# Altium schematic sheet FPGA_IOs.SchDoc
size A1
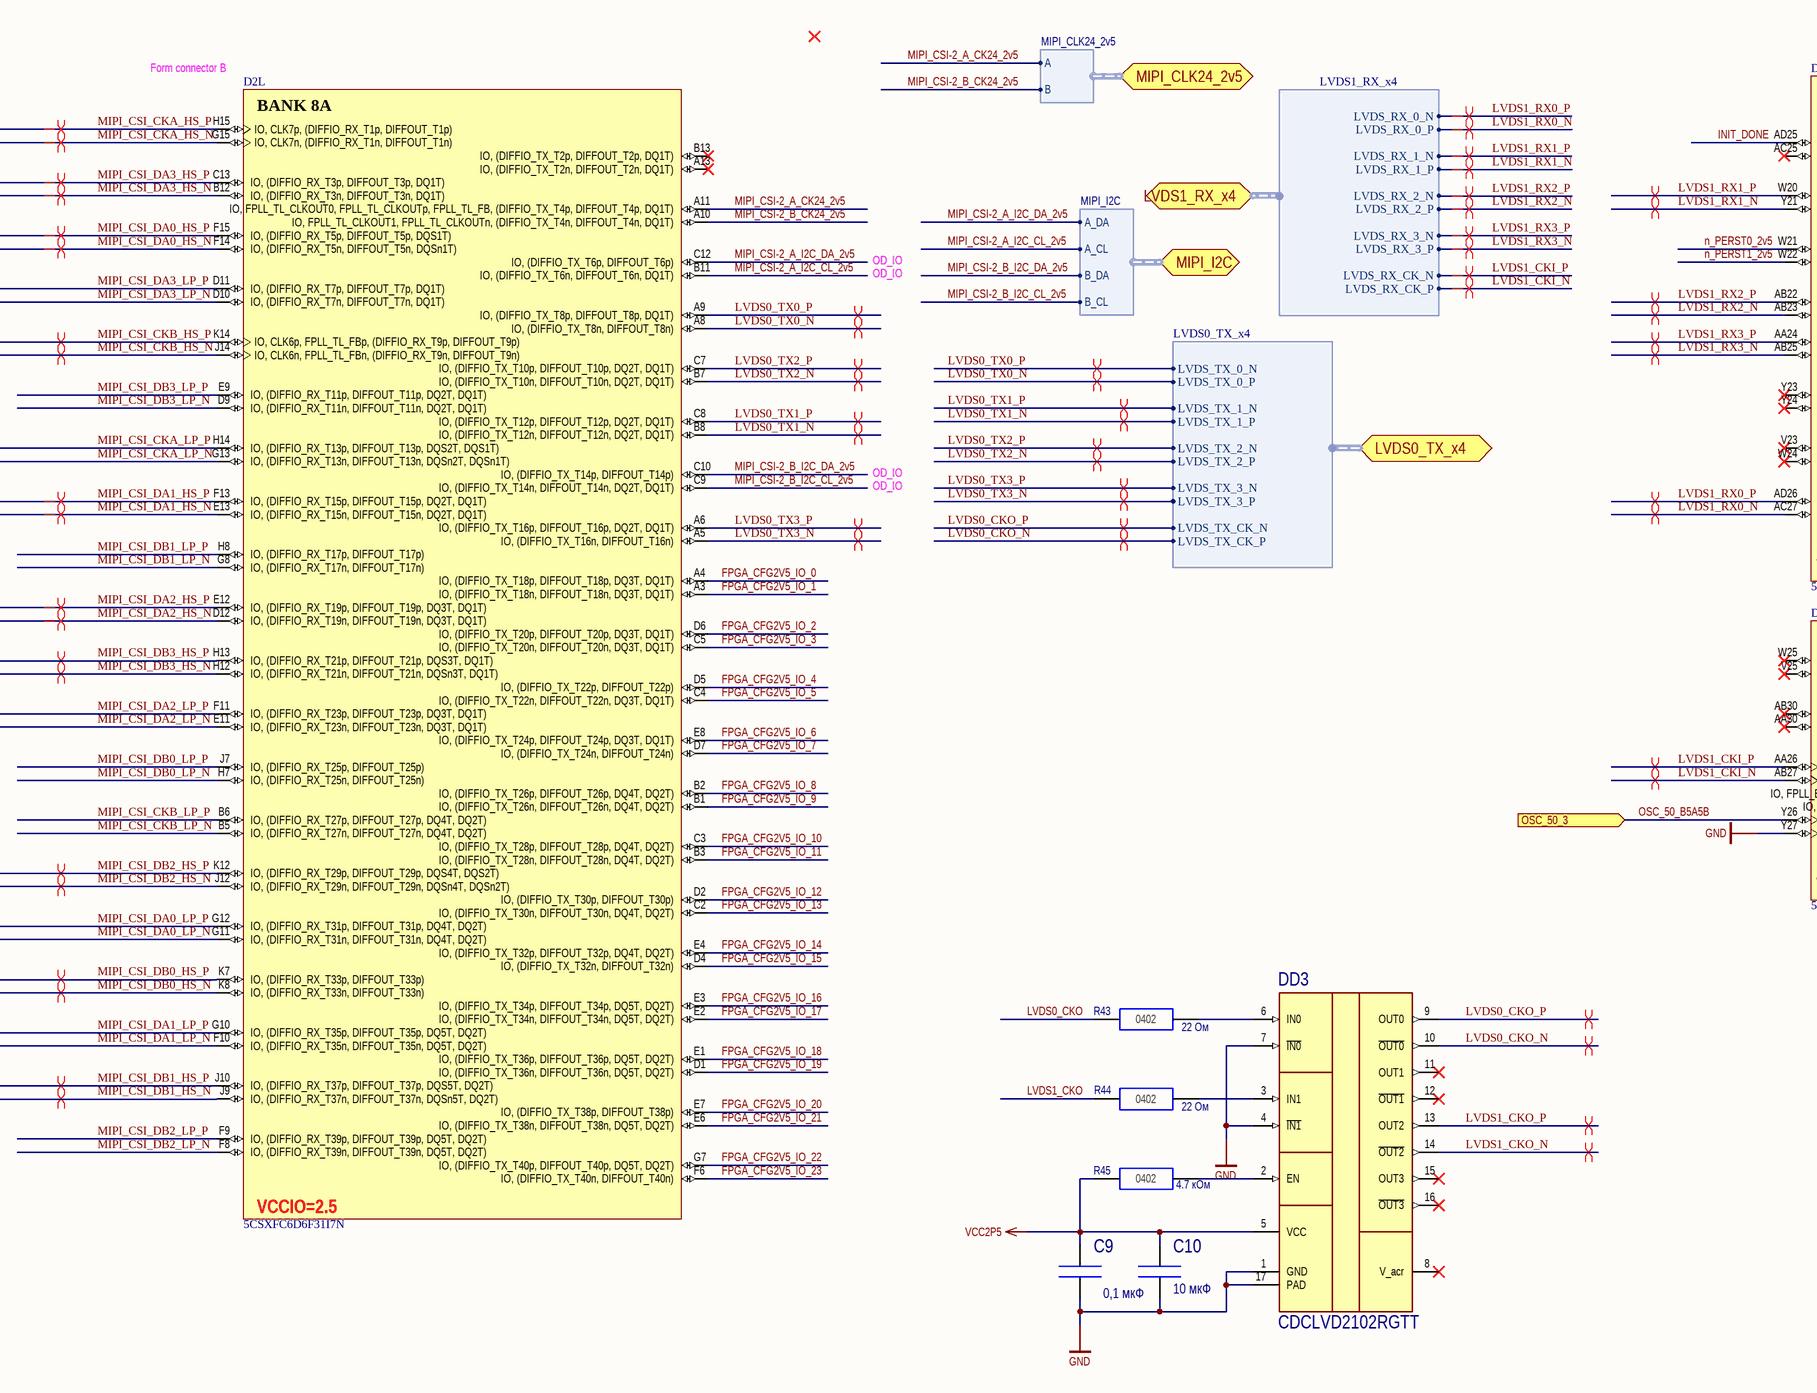
[diagram p0: FPGA_IOs.SchDoc, top left]
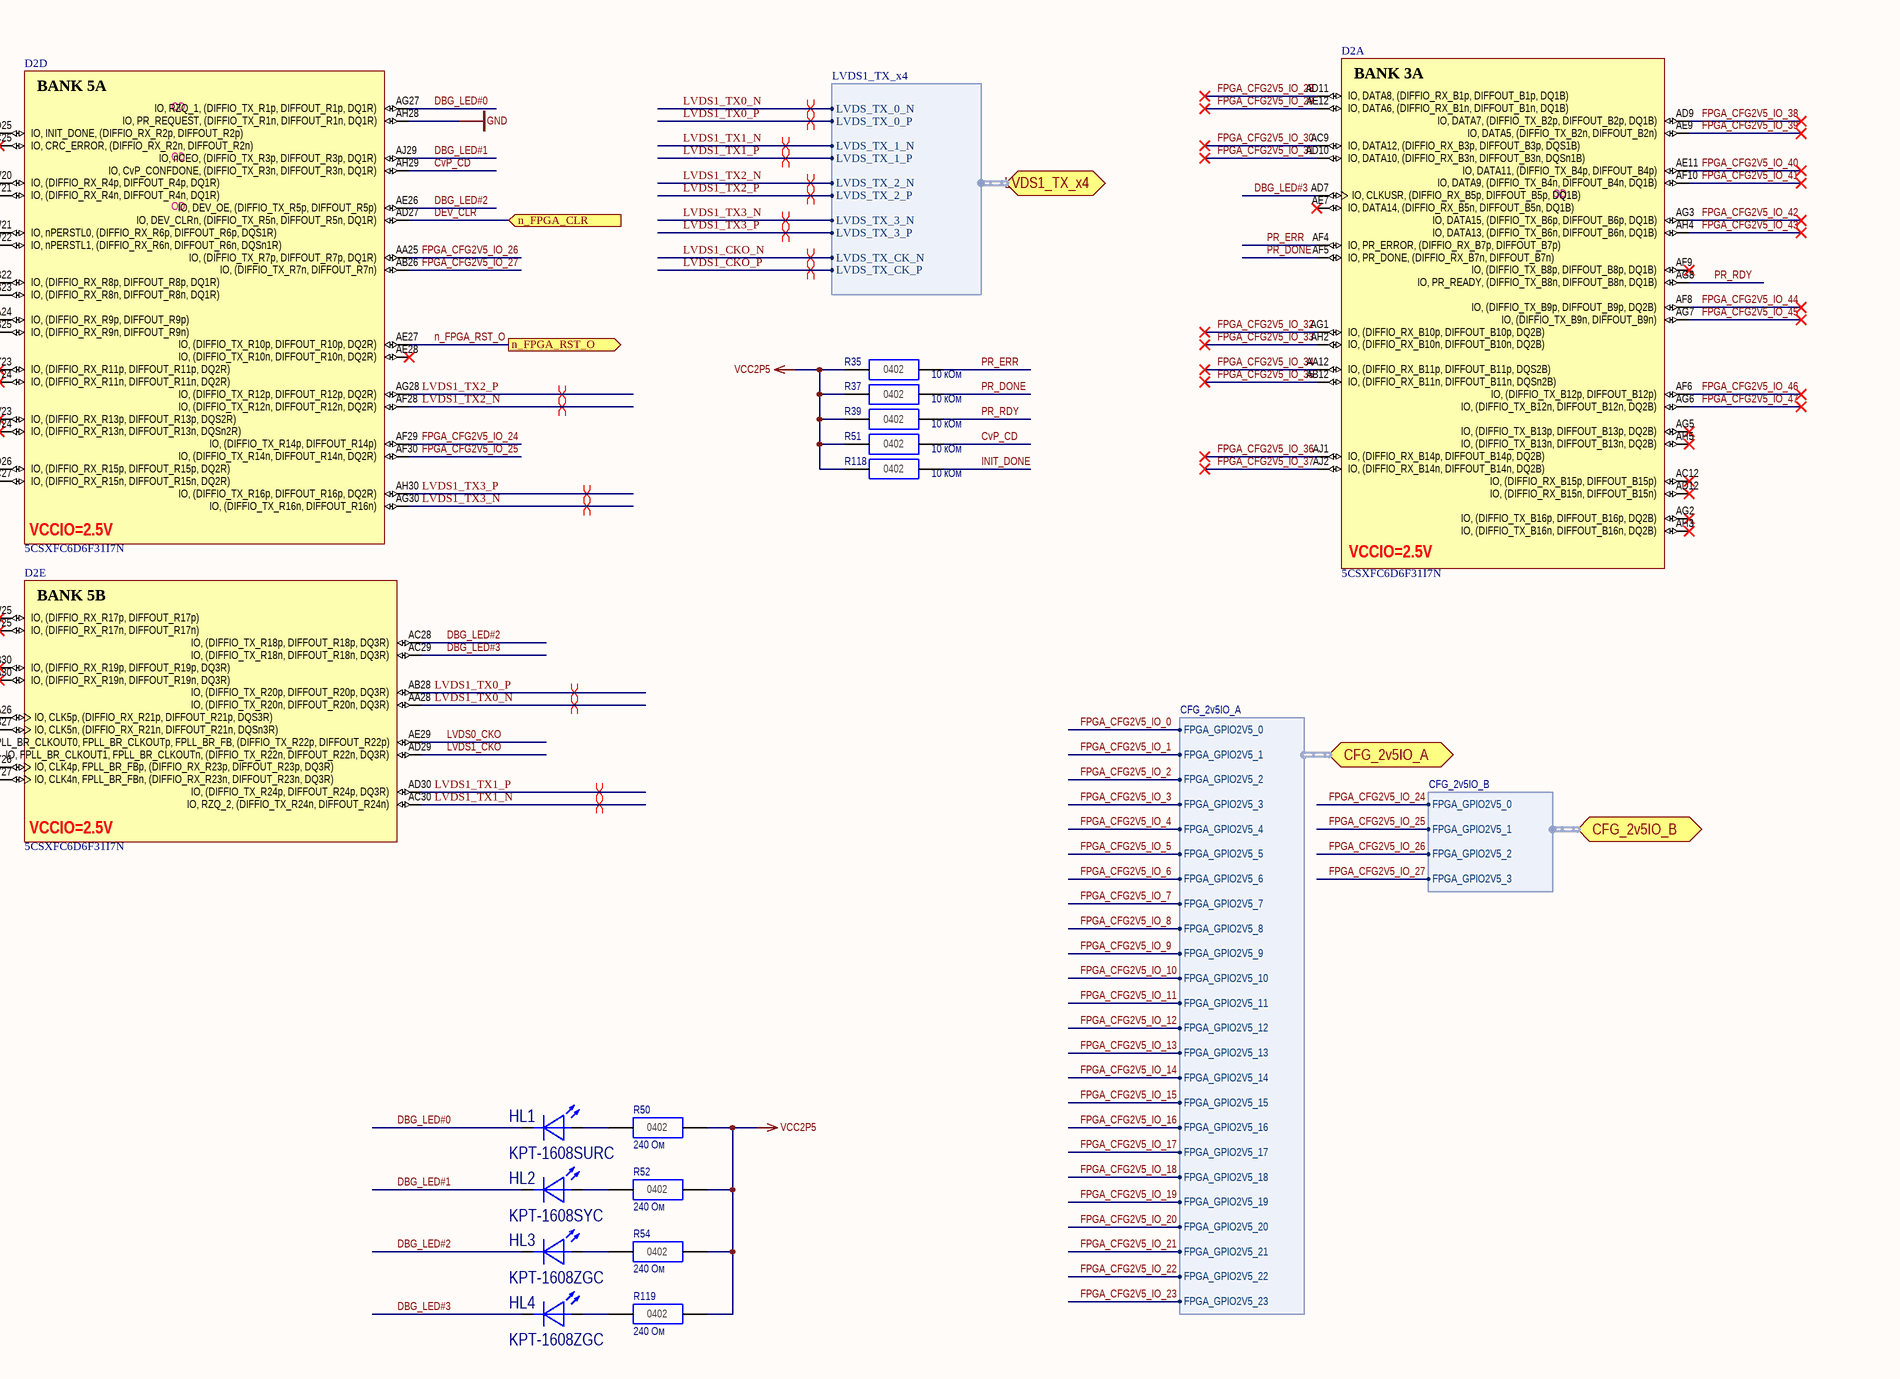
[diagram p1: FPGA_IOs.SchDoc, top right]
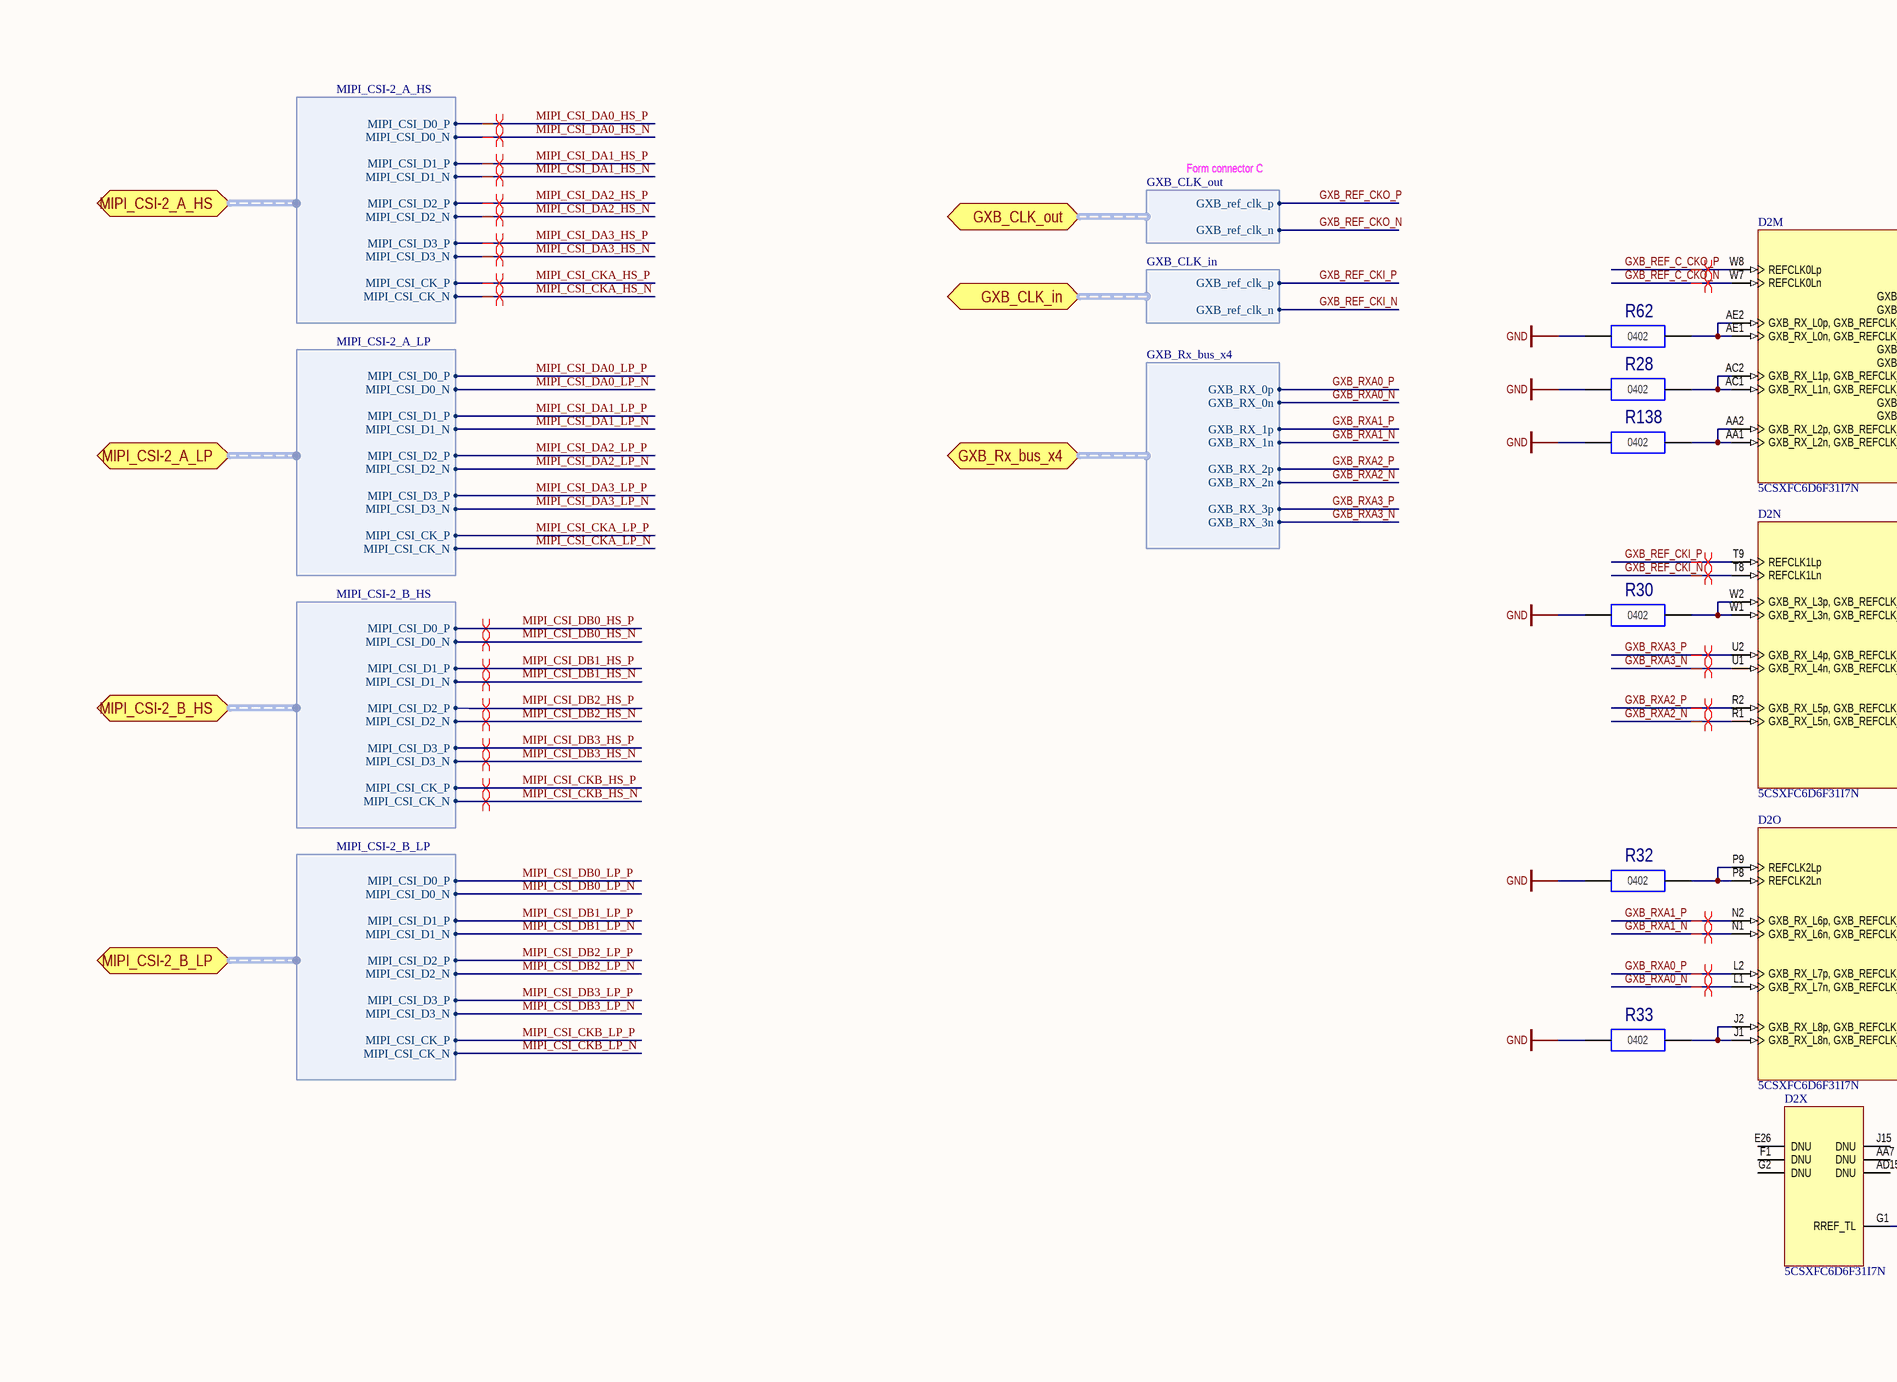
[diagram p2: FPGA_IOs.SchDoc, bottom left]
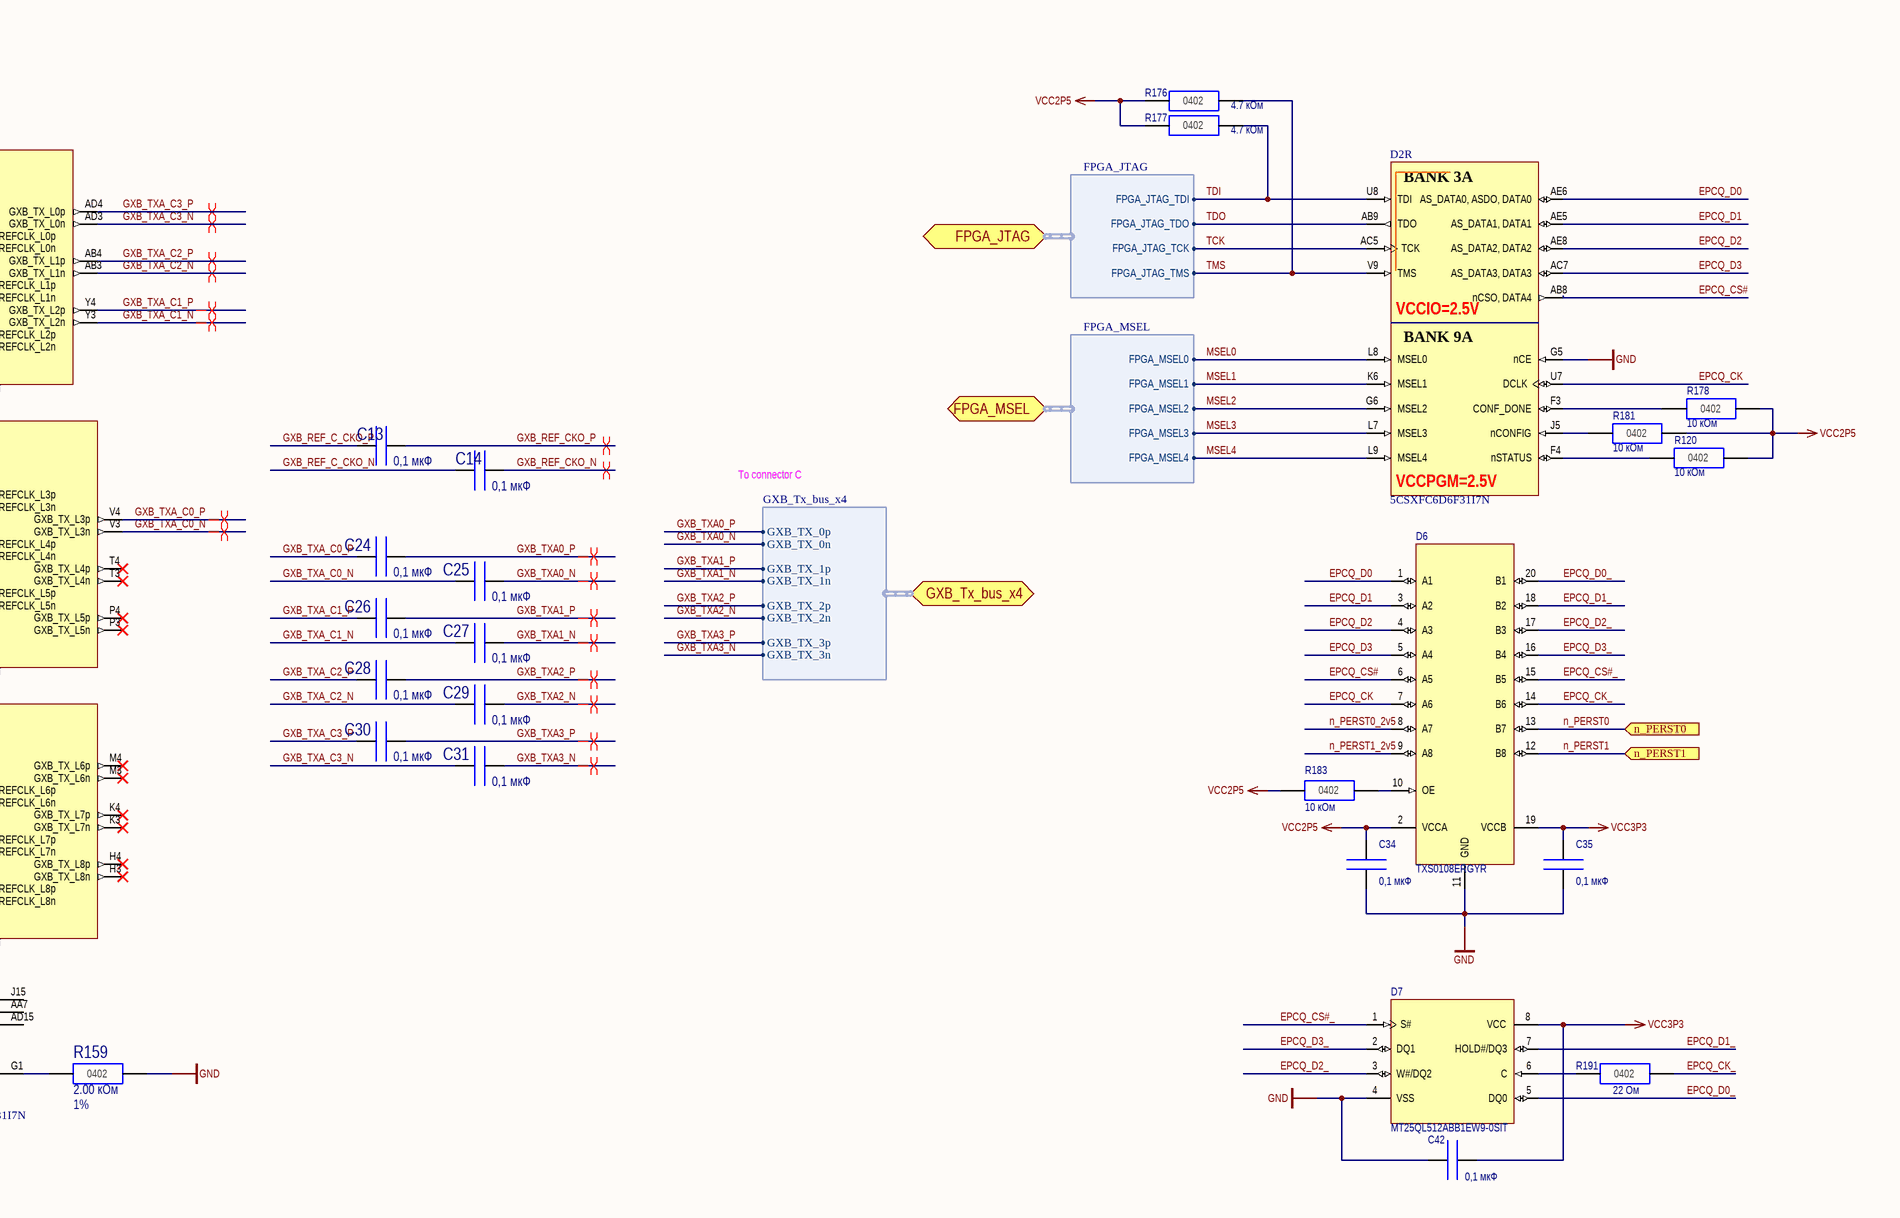
[diagram p3: FPGA_IOs.SchDoc, bottom right]

## Parts
C9  value 0,1 мкФ  [CC0402(1005)]  (hidden comment: CC0402-X7R-0,1 мкФ-20%-10В)
C10  value 10 мкФ  [CC0402(1005)]  (hidden comment: CC0402-X5R-10 мкФ-20%-6.3В)
C13  value 0,1 мкФ  [CC0402(1005)]  (hidden comment: CC0402-X7R-0,1 мкФ-20%-10В)
C14  value 0,1 мкФ  [CC0402(1005)]  (hidden comment: CC0402-X7R-0,1 мкФ-20%-10В)
C24  value 0,1 мкФ  [CC0402(1005)]  (hidden comment: CC0402-X7R-0,1 мкФ-20%-10В)
C25  value 0,1 мкФ  [CC0402(1005)]  (hidden comment: CC0402-X7R-0,1 мкФ-20%-10В)
C26  value 0,1 мкФ  [CC0402(1005)]  (hidden comment: CC0402-X7R-0,1 мкФ-20%-10В)
C27  value 0,1 мкФ  [CC0402(1005)]  (hidden comment: CC0402-X7R-0,1 мкФ-20%-10В)
C28  value 0,1 мкФ  [CC0402(1005)]  (hidden comment: CC0402-X7R-0,1 мкФ-20%-10В)
C29  value 0,1 мкФ  [CC0402(1005)]  (hidden comment: CC0402-X7R-0,1 мкФ-20%-10В)
C30  value 0,1 мкФ  [CC0402(1005)]  (hidden comment: CC0402-X7R-0,1 мкФ-20%-10В)
C31  value 0,1 мкФ  [CC0402(1005)]  (hidden comment: CC0402-X7R-0,1 мкФ-20%-10В)
C34  value 0,1 мкФ  [CC0402(1005)]  (hidden comment: CC0402-X7R-0,1 мкФ-20%-10В)
C35  value 0,1 мкФ  [CC0402(1005)]  (hidden comment: CC0402-X7R-0,1 мкФ-20%-10В)
C42  value 0,1 мкФ  [CC0402(1005)]  (hidden comment: CC0402-X7R-0,1 мкФ-20%-10В)
D2  5CSXFC6D6F31I7N  [ALTR-FBGA896_A-200]  (parts A,D,E,L,M,N,O,R,X of 24)
D6  TXS0108ERGYR  [QFN50P450X350X100_HS-21N]
D7  MT25QL512ABB1EW9-0SIT  [SON127P800X80_HS-9N]
DD3  CDCLVD2102RGTT  [QFN50P300X300X100_HS-17N]
HL1  KPT-1608SURC  [LED0603_Red]
HL2  KPT-1608SYC  [LED0603_Yellow]
HL3  KPT-1608ZGC  [LED0603_GREEN]
HL4  KPT-1608ZGC  [LED0603_GREEN]
R28  CR0402-0 Ом-±5%  [CR0402(1005)]  (value not drawn)
R30  CR0402-0 Ом-±5%  [CR0402(1005)]  (value not drawn)
R32  CR0402-0 Ом-±5%  [CR0402(1005)_OCT]  (value not drawn)
R33  CR0402-0 Ом-±5%  [CR0402(1005)]  (value not drawn)
R35  value 10 кОм  [CR0402(1005)_OCT]  (hidden comment: CR0402-10 кОм-±5%)
R37  value 10 кОм  [CR0402(1005)_OCT]  (hidden comment: CR0402-10 кОм-±5%)
R39  value 10 кОм  [CR0402(1005)_OCT]  (hidden comment: CR0402-10 кОм-±5%)
R43  value 22 Ом  [CR0402(1005)]  (hidden comment: CR0402-22 Ом-±5%)
R44  value 22 Ом  [CR0402(1005)]  (hidden comment: CR0402-22 Ом-±5%)
R45  value 4.7 кОм  [CR0402(1005)]  (hidden comment: CR0402-4.7 кОм-±5%)
R50  value 240 Ом  [CR0402(1005)]  (hidden comment: CR0402-240 Ом-±5%)
R51  value 10 кОм  [CR0402(1005)_OCT]  (hidden comment: CR0402-10 кОм-±5%)
R52  value 240 Ом  [CR0402(1005)]  (hidden comment: CR0402-240 Ом-±5%)
R54  value 240 Ом  [CR0402(1005)]  (hidden comment: CR0402-240 Ом-±5%)
R62  CR0402-0 Ом-±5%  [CR0402(1005)]  (value not drawn)
R118  value 10 кОм  [CR0402(1005)_OCT]  (hidden comment: CR0402-10 кОм-±5%)
R119  value 240 Ом  [CR0402(1005)]  (hidden comment: CR0402-240 Ом-±5%)
R120  value 10 кОм  [CR0402(1005)_OCT]  (hidden comment: CR0402-10 кОм-±5%)
R138  CR0402-0 Ом-±5%  [CR0402(1005)]  (value not drawn)
R159  value 2.00 кОм  TOLERANCE: 1%  [CR0402(1005)]  (hidden comment: CR0402-2.00 кОм-±1%)
R176  value 4.7 кОм  [CR0402(1005)_OCT]  (hidden comment: CR0402-4.7 кОм-±5%)
R177  value 4.7 кОм  [CR0402(1005)_OCT]  (hidden comment: CR0402-4.7 кОм-±5%)
R178  value 10 кОм  [CR0402(1005)_OCT]  (hidden comment: CR0402-10 кОм-±5%)
R181  value 10 кОм  [CR0402(1005)_OCT]  (hidden comment: CR0402-10 кОм-±5%)
R183  value 10 кОм  [CR0402(1005)]  (hidden comment: CR0402-10 кОм-±5%)
R191  value 22 Ом  [CR0402(1005)]  (hidden comment: CR0402-22 Ом-±5%)

## Ports
CFG_2v5IO_A (harness CFG_2v5IO_A), CFG_2v5IO_B (harness CFG_2v5IO_B), FPGA_JTAG (harness FPGA_JTAG), FPGA_MSEL (harness FPGA_MSEL), GXB_CLK_in (harness GXB_CLK_in), GXB_CLK_out (harness GXB_CLK_out), GXB_Rx_bus_x4 (harness GXB_Rx_bus_x4), GXB_Tx_bus_x4 (harness GXB_Tx_bus_x4), LVDS0_TX_x4 (harness LVDS0_TX_x4), LVDS1_RX_x4 (harness LVDS1_RX_x4), LVDS1_TX_x4 (harness LVDS1_TX_x4), MIPI_CLK24_2v5 (harness MIPI_CLK24_2v5), MIPI_CSI-2_A_HS (harness MIPI_CSI-2_A_HS), MIPI_CSI-2_A_LP (harness MIPI_CSI-2_A_LP), MIPI_CSI-2_B_HS (harness MIPI_CSI-2_B_HS), MIPI_CSI-2_B_LP (harness MIPI_CSI-2_B_LP), MIPI_I2C (harness MIPI_I2C), n_FPGA_CLR (in), n_FPGA_RST_O (out), n_PERST0 (in), n_PERST1 (in), OSC_50_3 (in)

## Harnesses
GXB_Rx_bus_x4: GXB_RX_0p, GXB_RX_0n, GXB_RX_1p, GXB_RX_1n, GXB_RX_2p, GXB_RX_2n, GXB_RX_3p, GXB_RX_3n
GXB_Tx_bus_x4: GXB_TX_0p, GXB_TX_0n, GXB_TX_1p, GXB_TX_1n, GXB_TX_2p, GXB_TX_2n, GXB_TX_3p, GXB_TX_3n
GXB_CLK_out: GXB_ref_clk_p, GXB_ref_clk_n
GXB_CLK_in: GXB_ref_clk_p, GXB_ref_clk_n
FPGA_JTAG: FPGA_JTAG_TDI, FPGA_JTAG_TDO, FPGA_JTAG_TCK, FPGA_JTAG_TMS
FPGA_MSEL: FPGA_MSEL0, FPGA_MSEL1, FPGA_MSEL2, FPGA_MSEL3, FPGA_MSEL4
CFG_2v5IO_A: FPGA_GPIO2V5_0, FPGA_GPIO2V5_1, FPGA_GPIO2V5_2, FPGA_GPIO2V5_3, FPGA_GPIO2V5_4, FPGA_GPIO2V5_5, FPGA_GPIO2V5_6, FPGA_GPIO2V5_7, FPGA_GPIO2V5_8, FPGA_GPIO2V5_9, FPGA_GPIO2V5_10, FPGA_GPIO2V5_11, FPGA_GPIO2V5_12, FPGA_GPIO2V5_13, FPGA_GPIO2V5_14, FPGA_GPIO2V5_15, FPGA_GPIO2V5_16, FPGA_GPIO2V5_17, FPGA_GPIO2V5_18, FPGA_GPIO2V5_19, FPGA_GPIO2V5_20, FPGA_GPIO2V5_21, FPGA_GPIO2V5_22, FPGA_GPIO2V5_23
MIPI_CSI-2_A_HS: MIPI_CSI_D0_N, MIPI_CSI_D0_P, MIPI_CSI_D1_N, MIPI_CSI_D1_P, MIPI_CSI_D2_P, MIPI_CSI_D2_N, MIPI_CSI_D3_N, MIPI_CSI_D3_P, MIPI_CSI_CK_N, MIPI_CSI_CK_P
MIPI_CSI-2_A_LP: MIPI_CSI_D0_N, MIPI_CSI_D0_P, MIPI_CSI_D1_N, MIPI_CSI_D1_P, MIPI_CSI_D2_P, MIPI_CSI_D2_N, MIPI_CSI_D3_N, MIPI_CSI_D3_P, MIPI_CSI_CK_N, MIPI_CSI_CK_P
MIPI_CSI-2_B_LP: MIPI_CSI_D0_N, MIPI_CSI_D0_P, MIPI_CSI_D1_N, MIPI_CSI_D1_P, MIPI_CSI_D2_P, MIPI_CSI_D2_N, MIPI_CSI_D3_N, MIPI_CSI_D3_P, MIPI_CSI_CK_N, MIPI_CSI_CK_P
MIPI_CSI-2_B_HS: MIPI_CSI_D0_N, MIPI_CSI_D0_P, MIPI_CSI_D1_N, MIPI_CSI_D1_P, MIPI_CSI_D2_P, MIPI_CSI_D2_N, MIPI_CSI_D3_N, MIPI_CSI_D3_P, MIPI_CSI_CK_N, MIPI_CSI_CK_P
LVDS1_RX_x4: LVDS_RX_0_P, LVDS_RX_0_N, LVDS_RX_1_P, LVDS_RX_1_N, LVDS_RX_2_P, LVDS_RX_2_N, LVDS_RX_3_P, LVDS_RX_3_N, LVDS_RX_CK_P, LVDS_RX_CK_N
LVDS0_TX_x4: LVDS_TX_0_P, LVDS_TX_0_N, LVDS_TX_1_P, LVDS_TX_1_N, LVDS_TX_2_P, LVDS_TX_2_N, LVDS_TX_3_P, LVDS_TX_3_N, LVDS_TX_CK_P, LVDS_TX_CK_N
MIPI_I2C: A_DA, A_CL, B_DA, B_CL
LVDS1_TX_x4: LVDS_TX_0_P, LVDS_TX_0_N, LVDS_TX_1_P, LVDS_TX_1_N, LVDS_TX_2_P, LVDS_TX_2_N, LVDS_TX_3_P, LVDS_TX_3_N, LVDS_TX_CK_P, LVDS_TX_CK_N
MIPI_CLK24_2v5: A, B
CFG_2v5IO_B: FPGA_GPIO2V5_0, FPGA_GPIO2V5_1, FPGA_GPIO2V5_2, FPGA_GPIO2V5_3
